# Altium schematic sheet Core.SchDoc
size A0; SheetNumber: 1; SheetTotal: 1
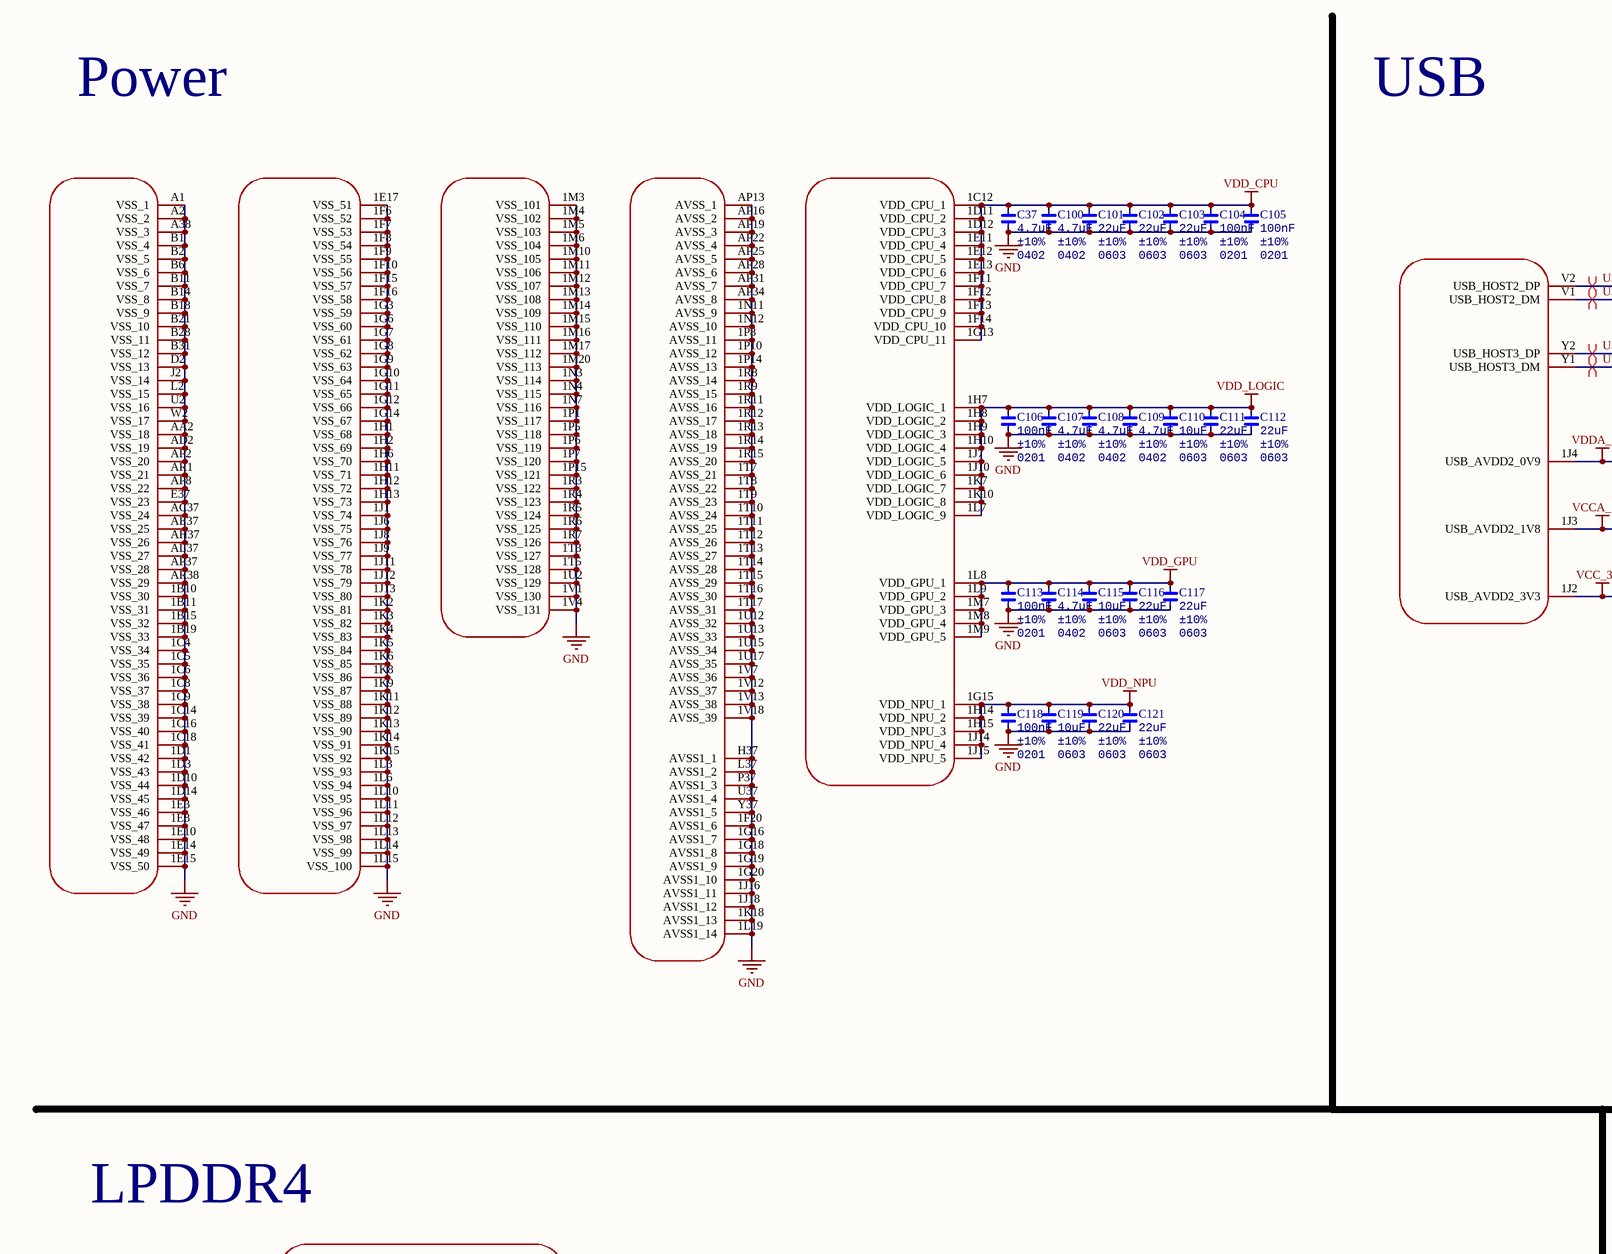
[diagram p0: Core.SchDoc, top left]
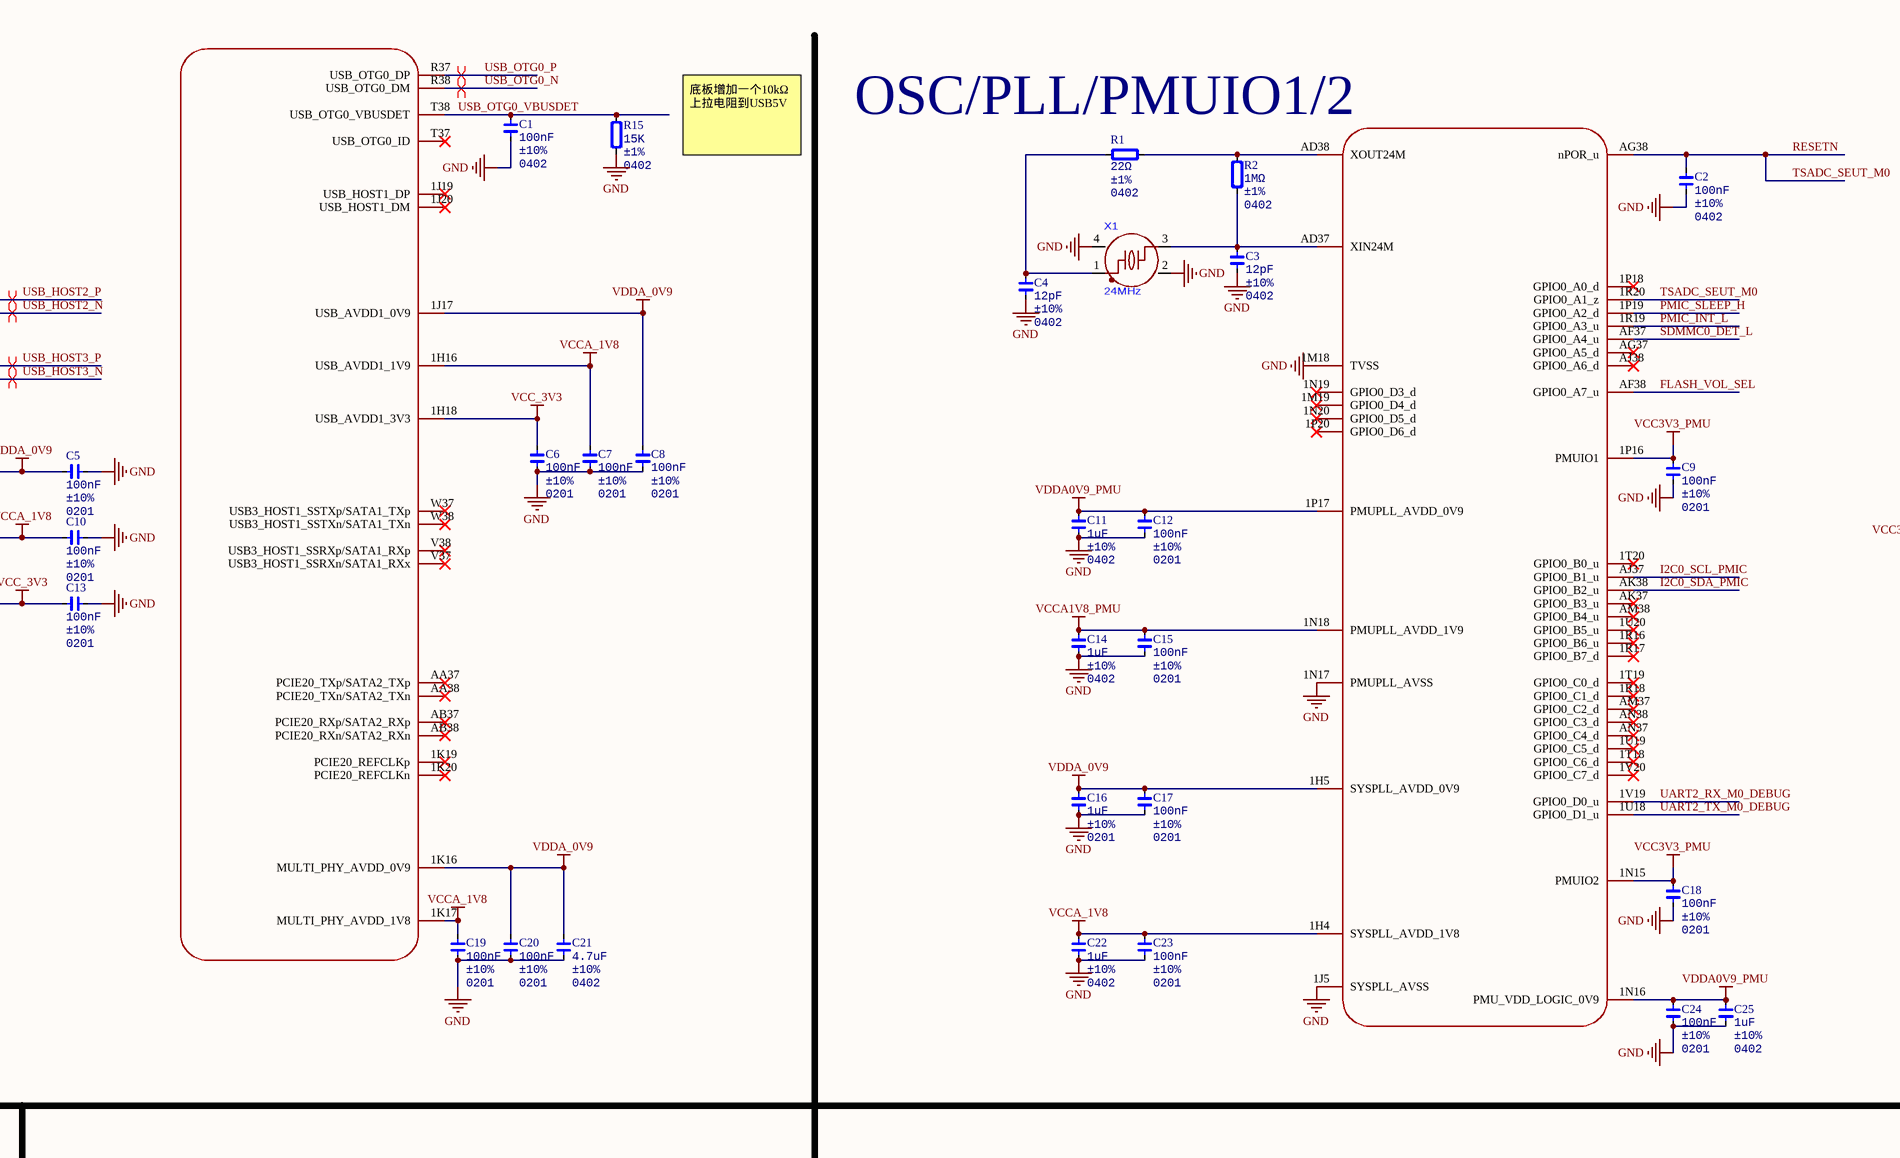
[diagram p1: Core.SchDoc, top middle]
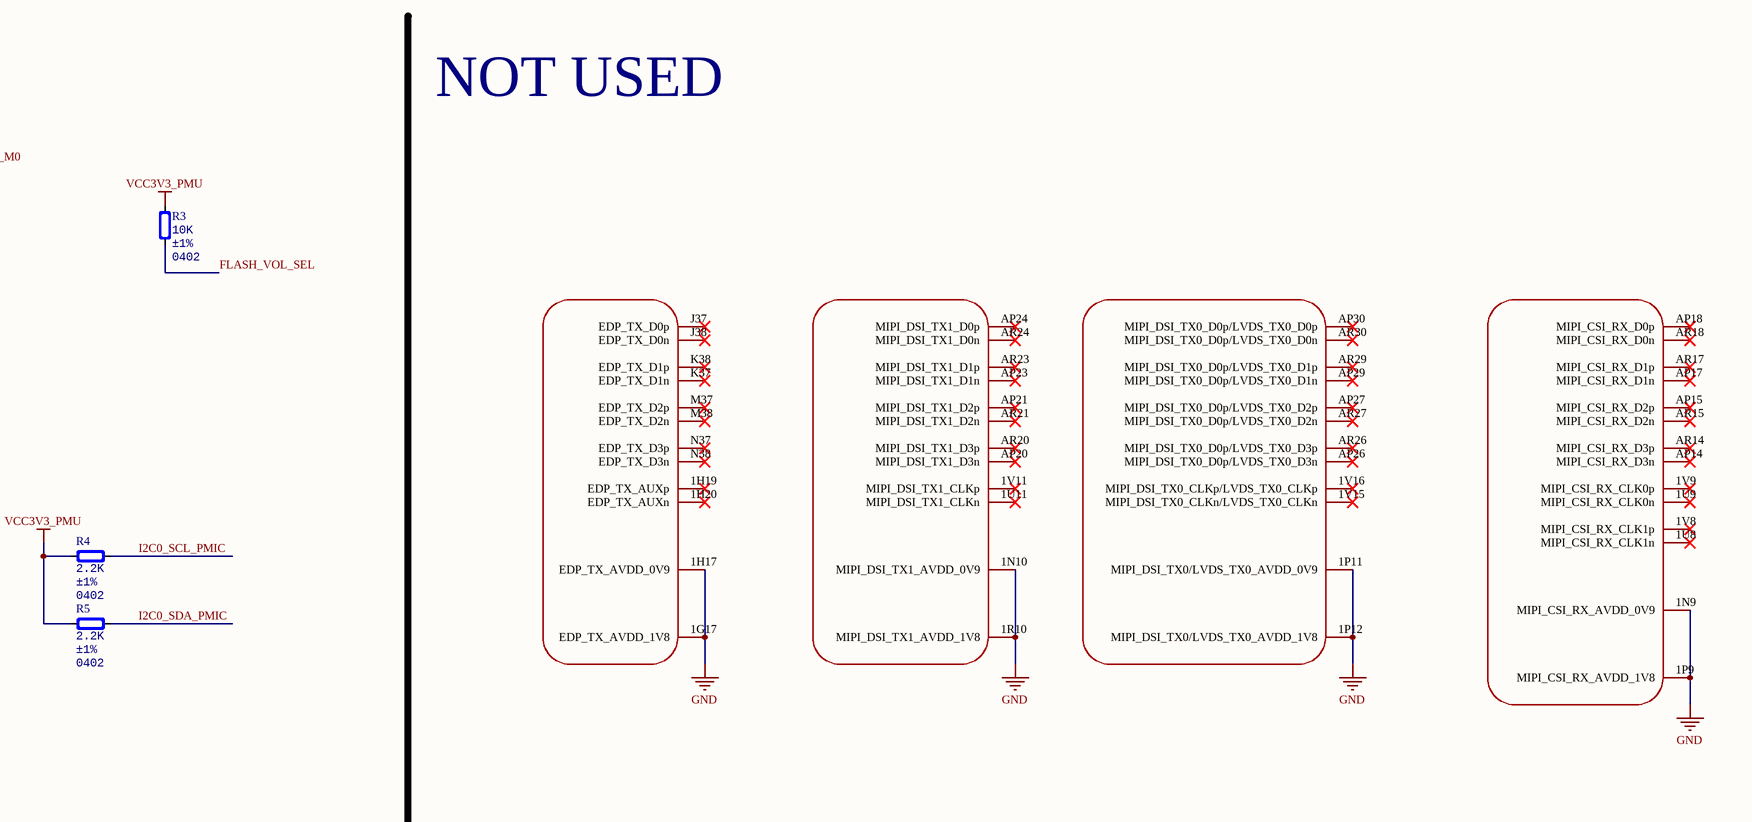
[diagram p2: Core.SchDoc, top right]
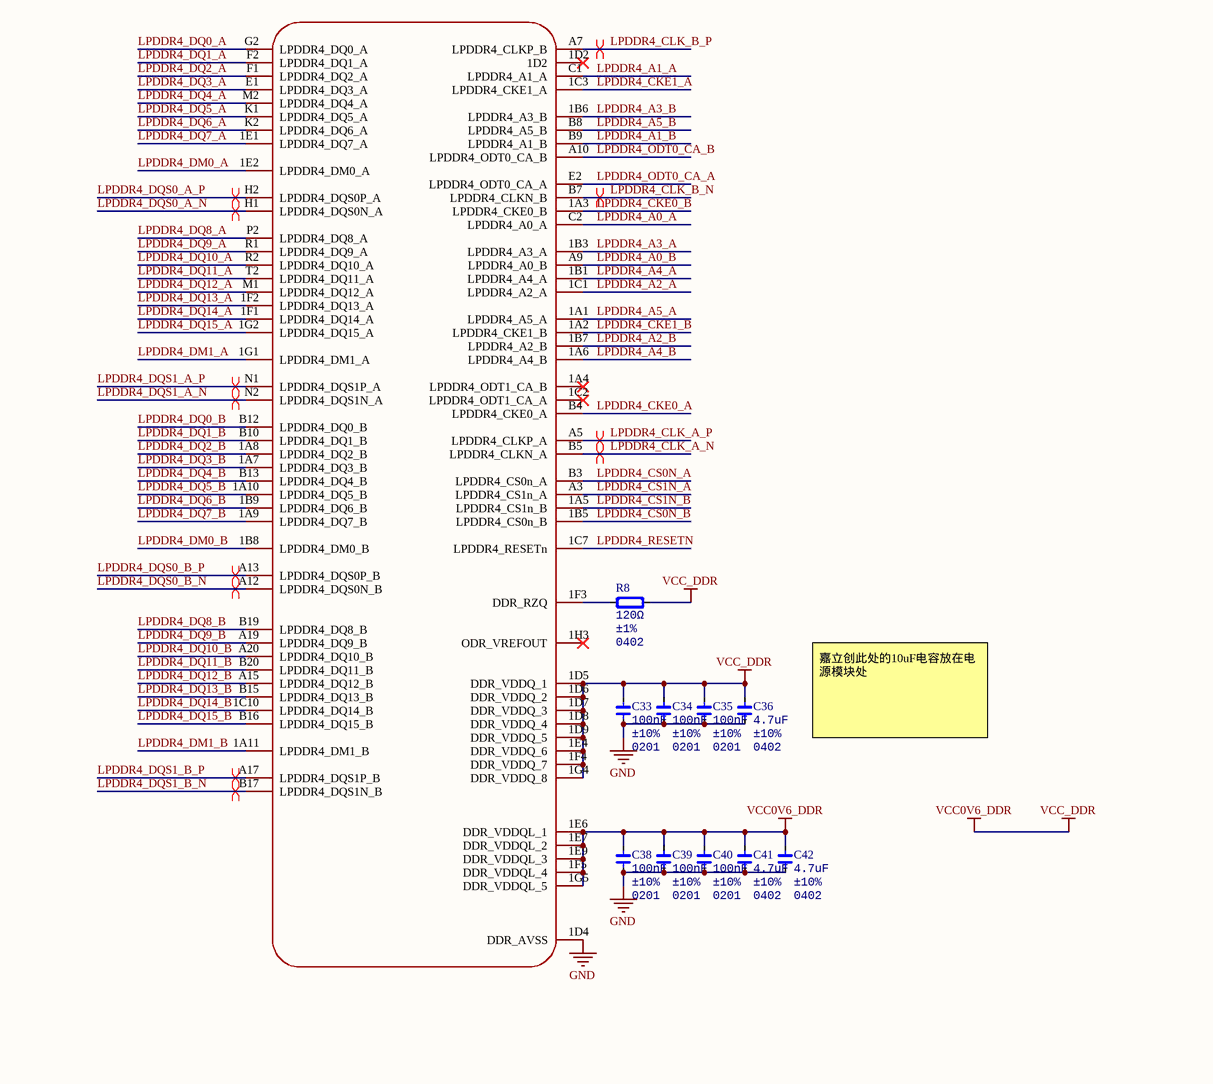
[diagram p3: Core.SchDoc, centre left]
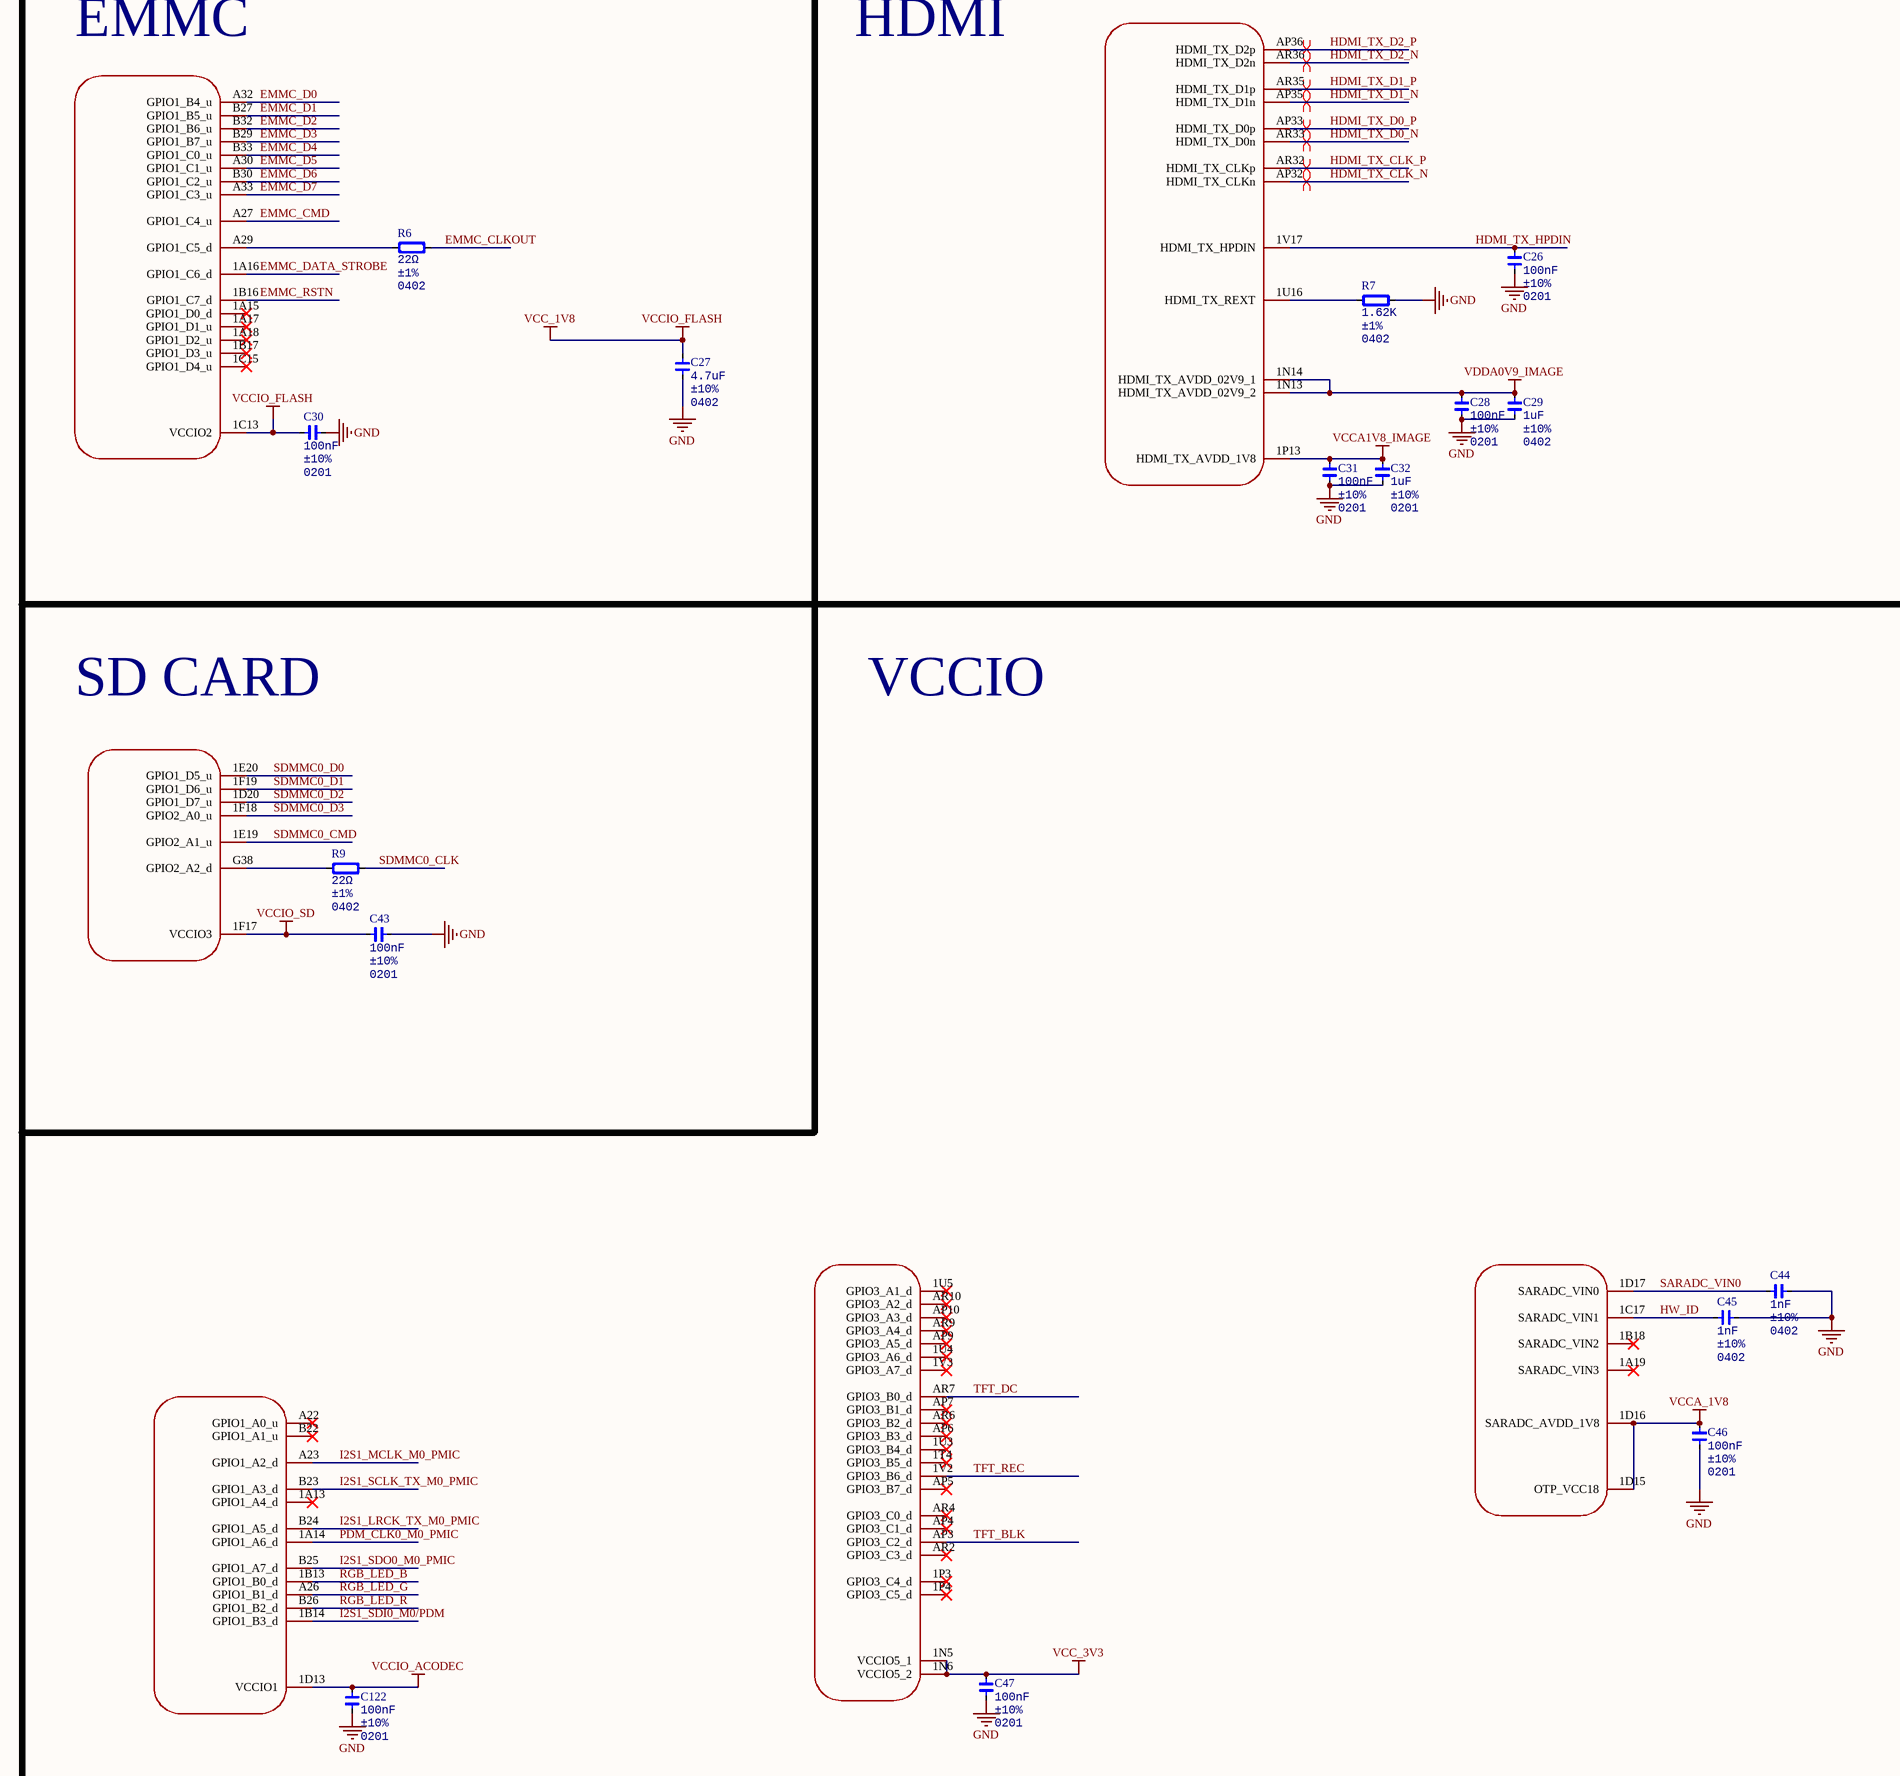
[diagram p4: Core.SchDoc, centre middle]
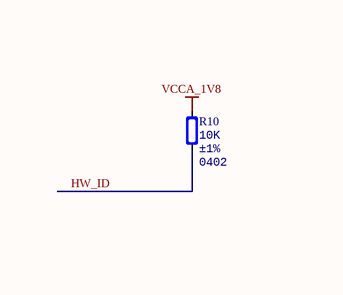
[diagram p5: Core.SchDoc, centre right]
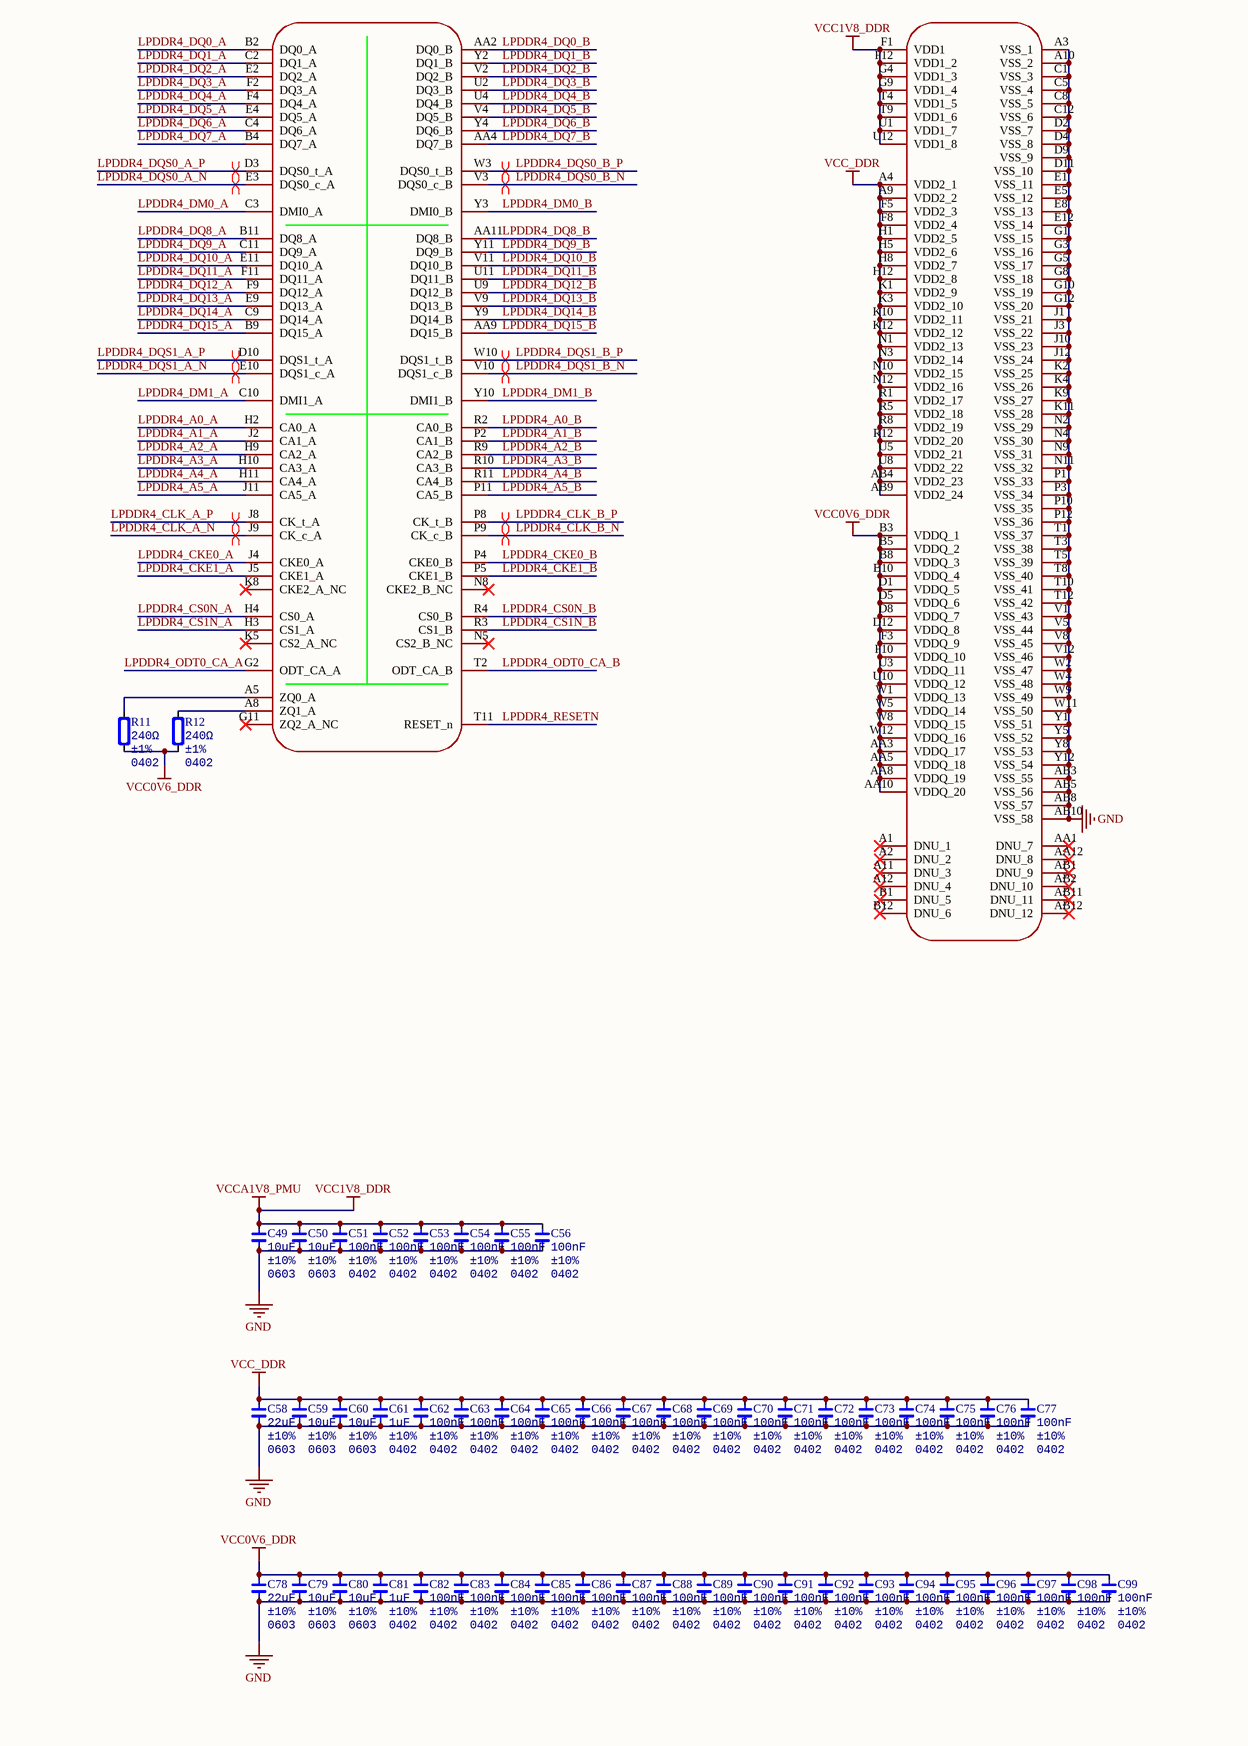
[diagram p6: Core.SchDoc, bottom left]
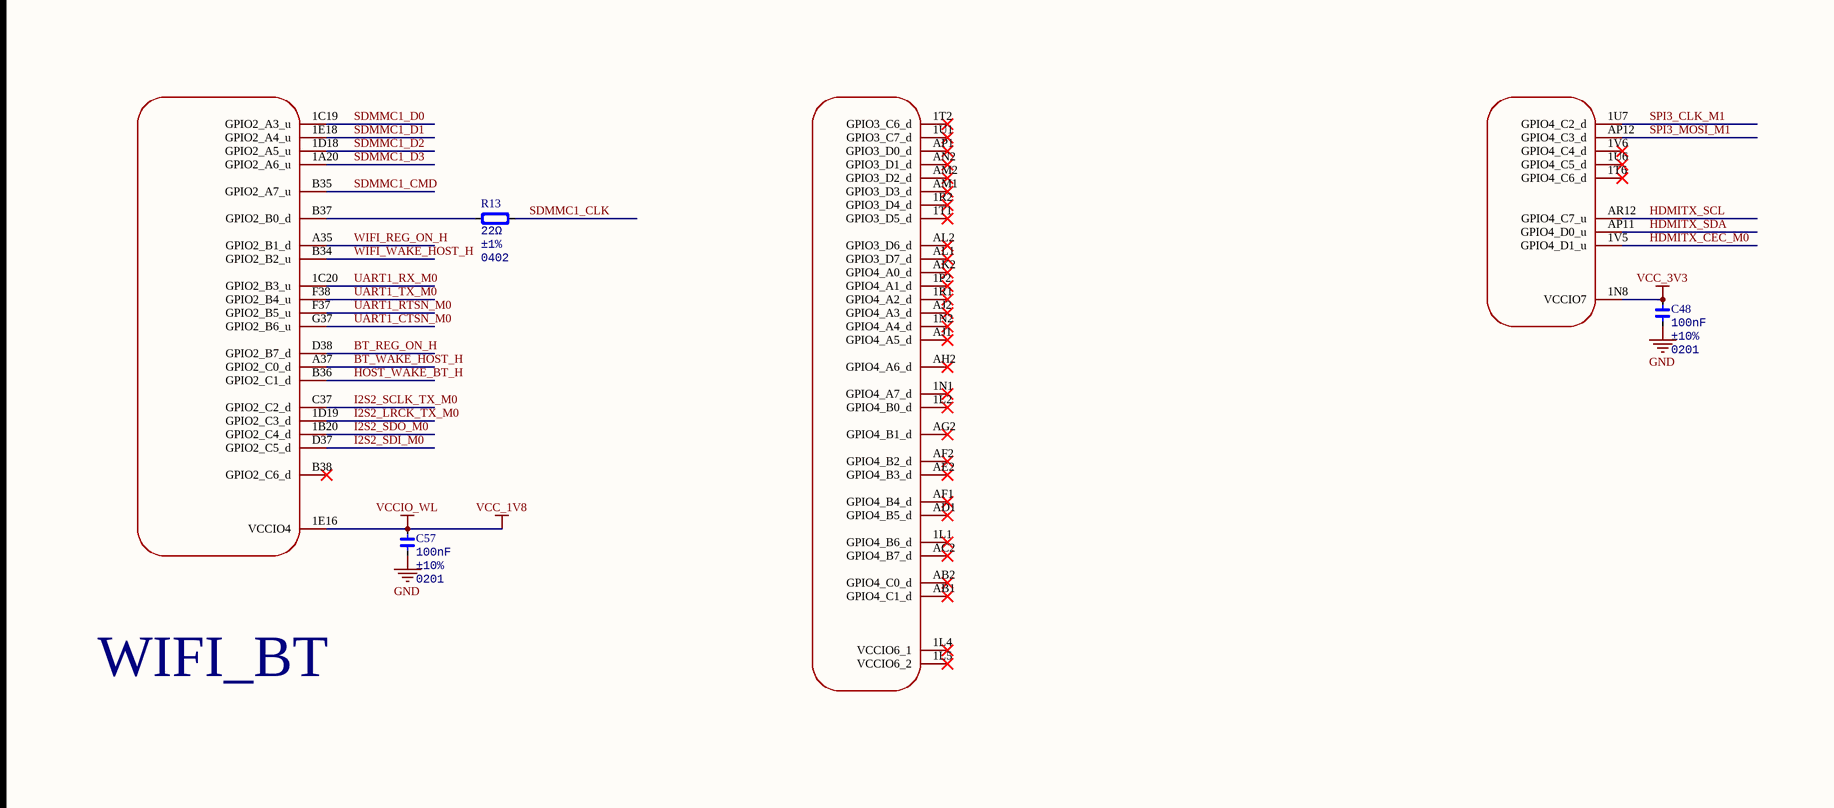
[diagram p7: Core.SchDoc, bottom middle]
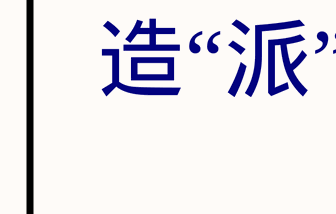
[diagram p8: Core.SchDoc, bottom right]

## Parts
C1  value 100nF  Note: ±10%  Type: 0402  [CAP_0402]  (hidden comment: C0402)
C2  value 100nF  Note: ±10%  Type: 0402  [CAP_0402]  (hidden comment: C0402)
C3  value 12pF  Note: ±10%  Type: 0402  [CAP_0402]  (hidden comment: C0402)
C4  value 12pF  Note: ±10%  Type: 0402  [CAP_0402]  (hidden comment: C0402)
C5  value 100nF  Note: ±10%  Type: 0201  [CAP_0201]  (hidden comment: C0201)
C6  value 100nF  Note: ±10%  Type: 0201  [CAP_0201]  (hidden comment: C0201)
C7  value 100nF  Note: ±10%  Type: 0201  [CAP_0201]  (hidden comment: C0201)
C8  value 100nF  Note: ±10%  Type: 0201  [CAP_0201]  (hidden comment: C0201)
C9  value 100nF  Note: ±10%  Type: 0201  [CAP_0201]  (hidden comment: C0201)
C10  value 100nF  Note: ±10%  Type: 0201  [CAP_0201]  (hidden comment: C0201)
C11  value 1uF  Note: ±10%  Type: 0402  [CAP_0402]  (hidden comment: C0402)
C12  value 100nF  Note: ±10%  Type: 0201  [CAP_0201]  (hidden comment: C0201)
C13  value 100nF  Note: ±10%  Type: 0201  [CAP_0201]  (hidden comment: C0201)
C14  value 1uF  Note: ±10%  Type: 0402  [CAP_0402]  (hidden comment: C0402)
C15  value 100nF  Note: ±10%  Type: 0201  [CAP_0201]  (hidden comment: C0201)
C16  value 1uF  Note: ±10%  Type: 0201  [CAP_0201]  (hidden comment: C0201)
C17  value 100nF  Note: ±10%  Type: 0201  [CAP_0201]  (hidden comment: C0201)
C18  value 100nF  Note: ±10%  Type: 0201  [CAP_0201]  (hidden comment: C0201)
C19  value 100nF  Note: ±10%  Type: 0201  [CAP_0201]  (hidden comment: C0201)
C20  value 100nF  Note: ±10%  Type: 0201  [CAP_0201]  (hidden comment: C0201)
C21  value 4.7uF  Note: ±10%  Type: 0402  [CAP_0402]  (hidden comment: C0402)
C22  value 1uF  Note: ±10%  Type: 0402  [CAP_0402]  (hidden comment: C0402)
C23  value 100nF  Note: ±10%  Type: 0201  [CAP_0201]  (hidden comment: C0201)
C24  value 100nF  Note: ±10%  Type: 0201  [CAP_0201]  (hidden comment: C0201)
C25  value 1uF  Note: ±10%  Type: 0402  [CAP_0402]  (hidden comment: C0402)
C26  value 100nF  Note: ±10%  Type: 0201  [CAP_0201]  (hidden comment: C0201)
C27  value 4.7uF  Note: ±10%  Type: 0402  [CAP_0402]  (hidden comment: C0402)
C28  value 100nF  Note: ±10%  Type: 0201  [CAP_0201]  (hidden comment: C0201)
C29  value 1uF  Note: ±10%  Type: 0402  [CAP_0402]  (hidden comment: C0402)
C30  value 100nF  Note: ±10%  Type: 0201  [CAP_0201]  (hidden comment: C0201)
C31  value 100nF  Note: ±10%  Type: 0201  [CAP_0201]  (hidden comment: C0201)
C32  value 1uF  Note: ±10%  Type: 0201  [CAP_0201]  (hidden comment: C0201)
C33  value 100nF  Note: ±10%  Type: 0201  [CAP_0201]  (hidden comment: C0201)
C34  value 100nF  Note: ±10%  Type: 0201  [CAP_0201]  (hidden comment: C0201)
C35  value 100nF  Note: ±10%  Type: 0201  [CAP_0201]  (hidden comment: C0201)
C36  value 4.7uF  Note: ±10%  Type: 0402  [CAP_0402]  (hidden comment: C0402)
C37  value 4.7uF  Note: ±10%  Type: 0402  [CAP_0402]  (hidden comment: C0402)
C38  value 100nF  Note: ±10%  Type: 0201  [CAP_0201]  (hidden comment: C0201)